# Altium schematic sheet mainboard.schdoc (part 2 of 2)
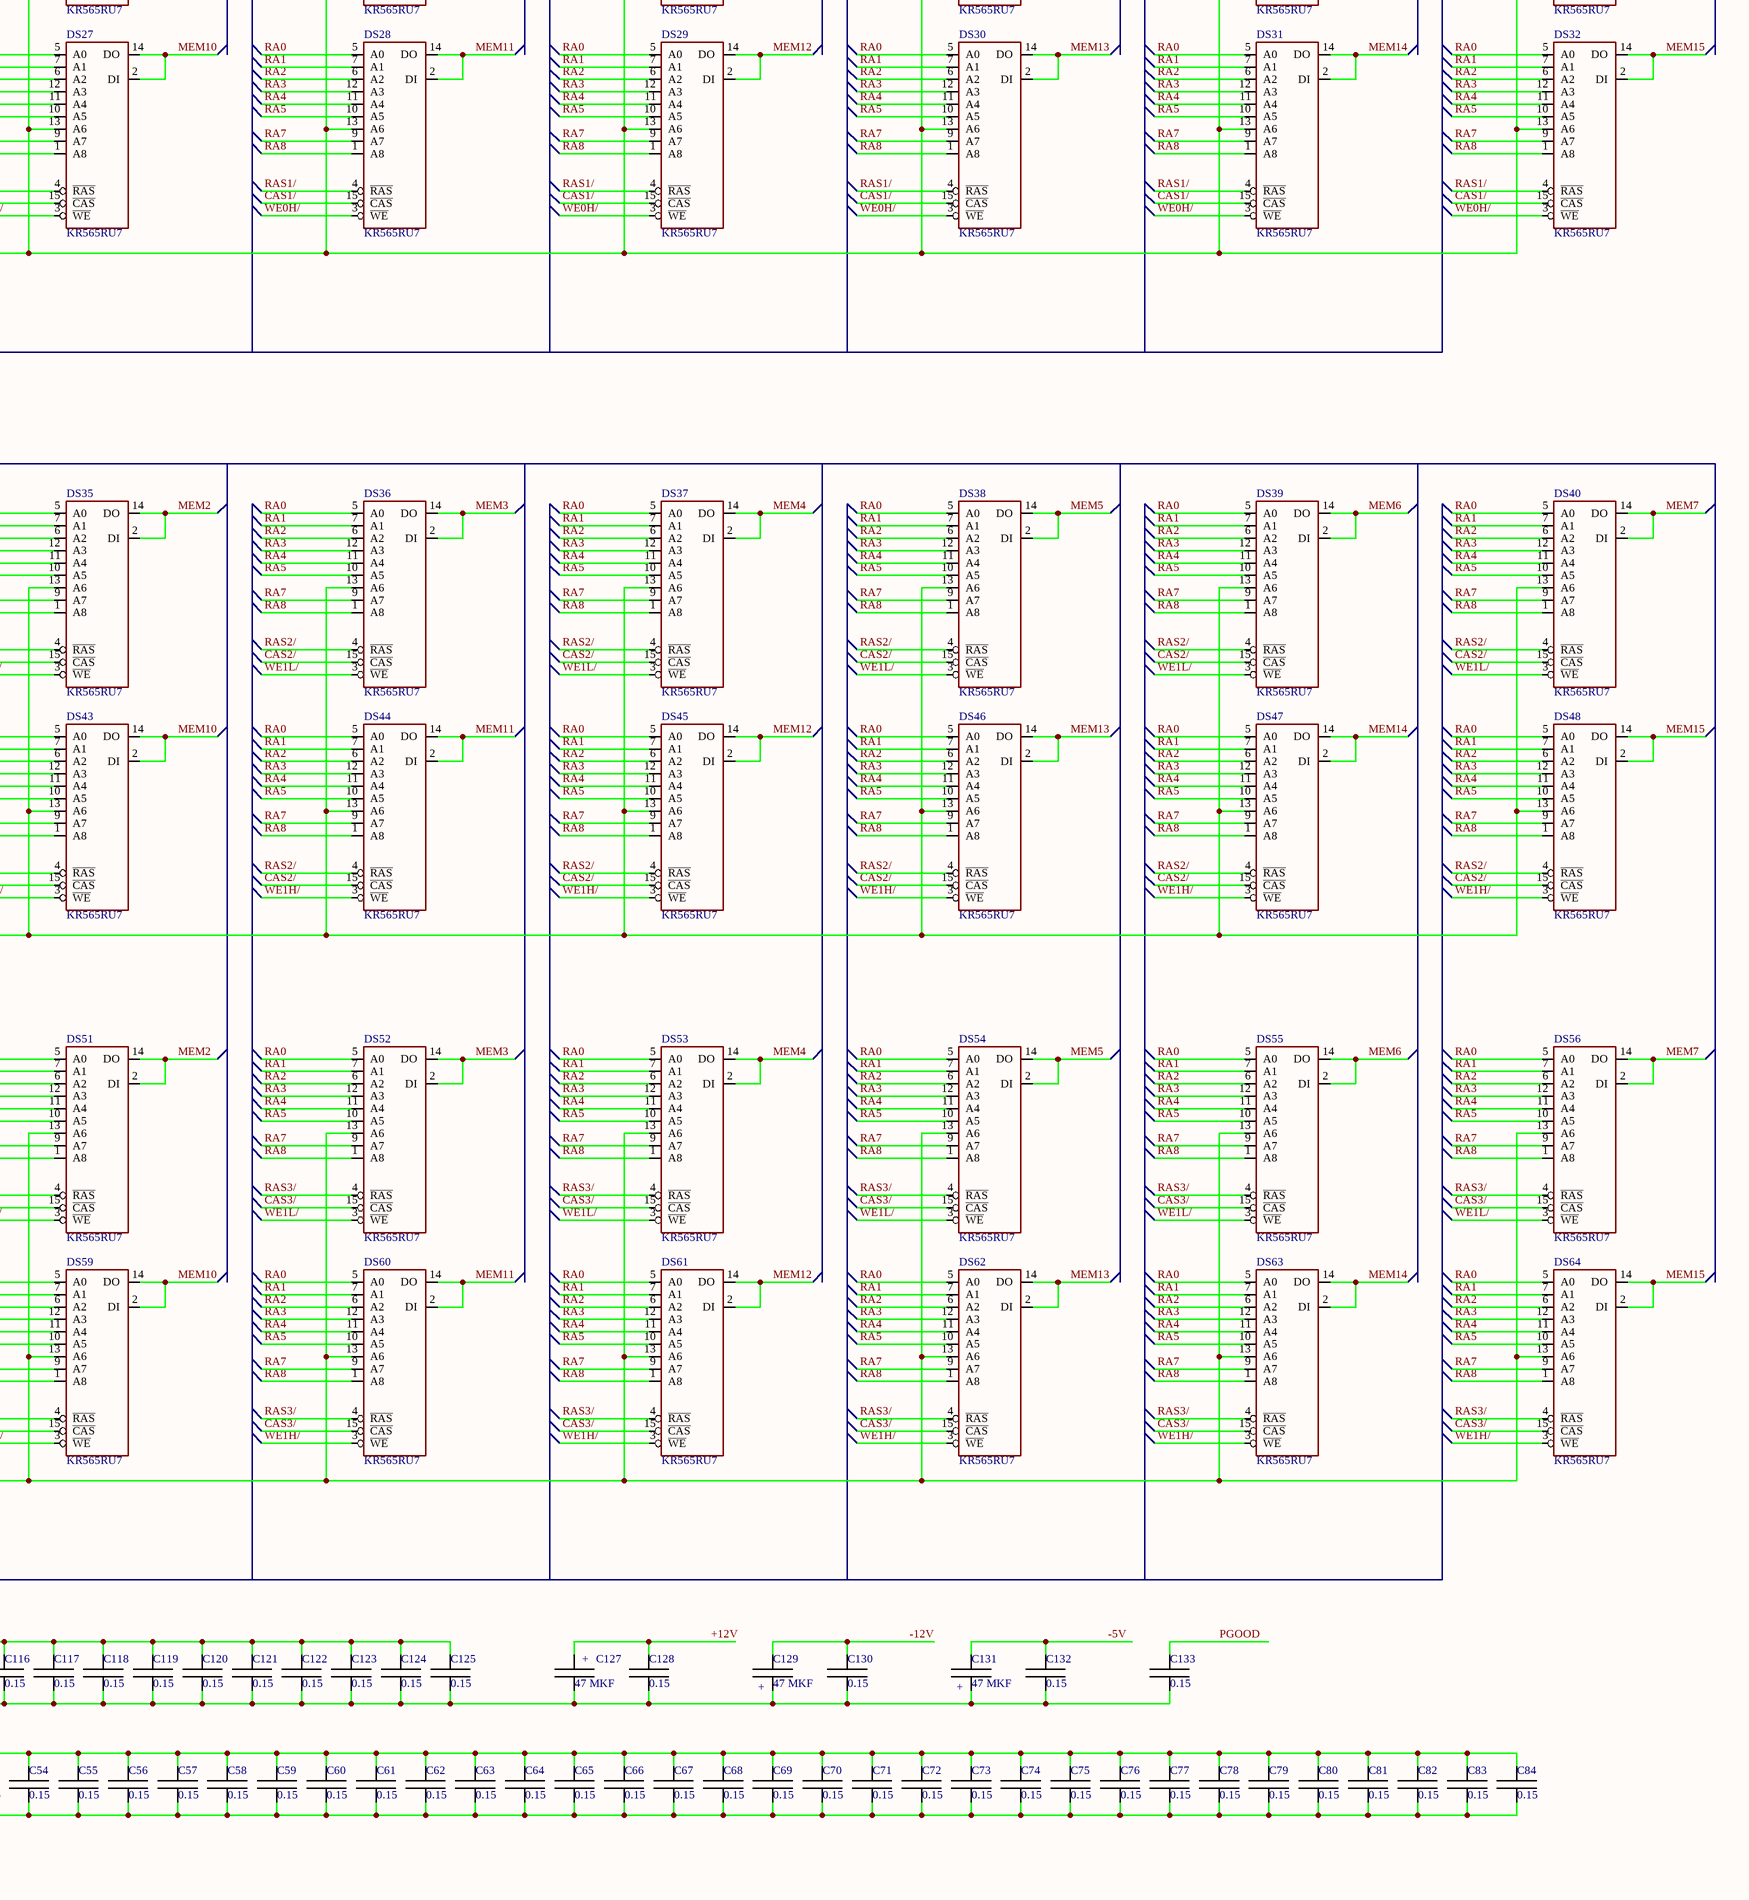
[diagram p6: mainboard.schdoc, bottom right]

## Nets
GND: BT1.2(-) C3.2 C4.2 C5.2 C6.2 C7.2 C8.2 C10.2 C11.2 C12.2 C13.2 C14.2 C15.2 C16.2 C17.2 C18.2 C19.2 C20.2 C21.2 C22.2 C23.2 C24.2 C25.2 C26.2 C27.2 C28.2 C29.2 C30.2 C31.2 C32.2 C33.2 C34.2 C35.2 C36.2 C37.2 C38.2 C39.2 C40.2 C41.2 C42.2 C43.2 C44.2 C45.2 C46.2 C47.2 C48.2 C49.2 C50.2 C51.2 C52.2 C53.2 C54.2 C55.2 C56.2 C57.2 C58.2 C59.2 C60.2 C61.2 C62.2 C63.2 C64.2 C65.2 C66.2 C67.2 C68.2 C69.2 C70.2 C71.2 C72.2 C73.2 C74.2 C75.2 C76.2 C77.2 C78.2 C79.2 C80.2 C81.2 C82.2 C83.2 C84.2 C85.2 C86.2 C87.2 C88.2 C89.2 C90.2 C91.2 C92.2 C93.2 C94.2 C95.2 C96.2 C97.2 C98.2 C99.2 C100.2 C101.2 C102.2 C103.2 C104.2 C105.2 C106.2 C107.2 C108.2 C109.2 C110.2 C111.2 C112.2 C113.2 C114.2 C115.2 C116.2 C117.2 C118.2 C119.2 C120.2 C121.2 C122.2 C123.2 C124.2 C125.2 C127.2 C128.2 C129.1 C130.2 C131.1 C132.2 C133.2 C134.2 D1.7 D2.7 D3.7 D4.7 D5.7 D6.7 D7.7 D7.8 D7.11 D8.8 D9.8 D10.7 D11.7 D12.1(A6) D12.8 D12.13(~{CE1}) D12.14(~{CE2}) D12.15(A7) D13.1(CSYNC) D13.6(RDY2) D13.7(~{AEN2}) D13.9 D13.13(F/~{C}) D14.7 D15.7 D16.7 D17.7 D18.7 D19.7 D20.8 D21.1 D21.20 D21.33(~{MX}) D22.1 D22.20 D23.7 D24.7 D25.10 D26.10 D27.10 D28.10 D29.10 D30.1(IOB) D30.10 D31.7 D32.8 D32.13(~{CE1}) D32.14(~{CE2}) D33.10 D34.7 D35.7 D36.7 D37.7 D38.10 D38.19(S1) D39.6(RO(1)) D39.7(RO(2)) D39.10 D40.14 D41.10 D42.7 D43.10 D44.12 D45.7 D46.10 D46.19(G) D47.20 D48.8 D49.12 D50.7 D51.2(A1) D51.10 D51.19(EY) D52.10 D53.1(EX) D53.10 D53.19(EY) D54.12(VSS) D55.1(A6) D55.8 D55.13(~{CE1}) D55.14(~{CE2}) D55.15(A7) D56.10 D57.10 D58.10 D59.14 D59.20(~{CE}) D60.14 D60.20(~{CE}) D61.7 D62.7 D63.7 D64.7 D65.7 D66.8 D67.10 D67.15(B3) D67.17(B4) D68.8 D69.8 D70.8(~{CS}) D70.9 D70.15(A9) D70.16(A8) D71.8(~{CS}) D71.9 D71.15(A9) D71.16(A8) D72.1(G) D72.10 D72.19(G) D73.8 D73.15(G) D74.8 D74.15(G) D75.1(1G) D75.8 D75.15(2G) D76.5(G2B) D76.8 D77.10 DS1.16 DS2.16 DS3.16 DS4.16 DS5.16 DS6.16 DS7.16 DS8.16 DS9.16 DS10.16 DS11.16 DS12.16 DS13.16 DS14.16 DS15.16 DS16.16 DS17.16 DS18.16 DS19.16 DS20.16 DS21.16 DS22.16 DS23.16 DS24.16 DS25.16 DS26.16 DS27.16 DS28.16 DS29.16 DS30.16 DS31.16 DS32.16 DS33.16 DS34.16 DS35.16 DS36.16 DS37.16 DS38.16 DS39.16 DS40.16 DS41.16 DS42.16 DS43.16 DS44.16 DS45.16 DS46.16 DS47.16 DS48.16 DS49.16 DS50.16 DS51.16 DS52.16 DS53.16 DS54.16 DS55.16 DS56.16 DS57.16 DS58.16 DS59.16 DS60.16 DS61.16 DS62.16 DS63.16 DS64.16 R5.2 R6.1 R9.1 R21.2 VT2.E X1.1 X4.4 X5.5 X5.6 X5.7 X5.8 X7.32(B1) X7.41(B10) X7.62(B31) X8.32(B1) X8.41(B10) X8.62(B31) X9.32(B1) X9.41(B10) X9.62(B31) X10.32(B1) X10.41(B10) X10.62(B31) X11.32(B1) X11.41(B10) X11.62(B31) X12.32(B1) X12.41(B10) X12.62(B31) X13.32(B1) X13.41(B10) X13.62(B31) X14.32(B1) X14.41(B10) X14.62(B31) X15.2
VCC: C8.1 C10.1 C11.1 C12.1 C13.1 C14.1 C15.1 C16.1 C17.1 C18.1 C19.1 C20.1 C21.1 C22.1 C23.1 C24.1 C25.1 C26.1 C27.1 C28.1 C29.1 C30.1 C31.1 C32.1 C33.1 C34.1 C35.1 C36.1 C37.1 C38.1 C39.1 C40.1 C41.1 C42.1 C43.1 C44.1 C45.1 C46.1 C47.1 C48.1 C49.1 C50.1 C51.1 C52.1 C53.1 C54.1 C55.1 C56.1 C57.1 C58.1 C59.1 C60.1 C61.1 C62.1 C63.1 C64.1 C65.1 C66.1 C67.1 C68.1 C69.1 C70.1 C71.1 C72.1 C73.1 C74.1 C75.1 C76.1 C77.1 C78.1 C79.1 C80.1 C81.1 C82.1 C83.1 C84.1 C85.1 C86.1 C87.1 C88.1 C89.1 C90.1 C91.1 C92.1 C93.1 C94.1 C95.1 C96.1 C97.1 C98.1 C99.1 C100.1 C101.1 C102.1 C103.1 C104.1 C105.1 C106.1 C107.1 C108.1 C109.1 C110.1 C111.1 C112.1 C113.1 C114.1 C115.1 C116.1 C117.1 C118.1 C119.1 C120.1 C121.1 C122.1 C123.1 C124.1 C125.1 D1.14 D2.14 D3.14 D4.14 D5.14 D6.14 D7.14 D8.16 D9.16 D10.14 D11.14 D12.16 D13.18 D14.14 D15.14 D16.14 D17.14 D18.14 D19.14 D20.16 D21.40 D22.33(RQ/GT1) D22.40 D23.14 D24.14 D25.20 D26.20 D27.20 D28.20 D29.20 D30.20 D31.14 D32.16 D33.20 D34.14 D35.14 D36.14 D37.14 D38.20 D39.5 D40.28 D41.20 D42.14 D43.20 D44.24 D45.26 D46.20 D47.31 D48.16 D49.11(G0) D49.14(G1) D49.24 D51.20 D52.20 D53.20 D55.16 D56.20 D57.20 D58.20 D59.1(VPP) D59.28 D60.1(VPP) D60.28 D61.14 D62.14 D63.14 D64.14 D65.14 D66.16 D67.20 D68.16 D69.16 D70.18 D71.18 D72.20 D73.16 D74.16 D75.16 D76.16 D77.20 DR1.1 DR2.1 DR3.1 DR7.1 DR8.1 DR9.1 DS1.8 DS2.8 DS3.8 DS4.8 DS5.8 DS6.8 DS7.8 DS8.8 DS9.8 DS10.8 DS11.8 DS12.8 DS13.8 DS14.8 DS15.8 DS16.8 DS17.8 DS18.8 DS19.8 DS20.8 DS21.8 DS22.8 DS23.8 DS24.8 DS25.8 DS26.8 DS27.8 DS28.8 DS29.8 DS30.8 DS31.8 DS32.8 DS33.8 DS34.8 DS35.8 DS36.8 DS37.8 DS38.8 DS39.8 DS40.8 DS41.8 DS42.8 DS43.8 DS44.8 DS45.8 DS46.8 DS47.8 DS48.8 DS49.8 DS50.8 DS51.8 DS52.8 DS53.8 DS54.8 DS55.8 DS56.8 DS57.8 DS58.8 DS59.8 DS60.8 DS61.8 DS62.8 DS63.8 DS64.8 R1.2 R2.1 R4.1 R7.1 R8.1 R10.2 R12.1 R13.1 R14.1 R15.1 R17.2 R20.2 R23.1 R25.2 R28.1 R29.2 R30.1 R31.2 R32.2 R33.2 R34.2 R35.2 R36.2 R37.2 VT1.E X2.2 X4.5 X5.2 X5.10 X5.11 X5.12 X7.34(B3) X7.60(B29) X8.34(B3) X8.60(B29) X9.34(B3) X9.60(B29) X10.34(B3) X10.60(B29) X11.34(B3) X11.60(B29) X12.34(B3) X12.60(B29) X13.34(B3) X13.60(B29) X14.34(B3) X14.60(B29)
+12V: C127.1 C128.1 X5.3 X7.40(B9) X8.40(B9) X9.40(B9) X10.40(B9) X11.40(B9) X12.40(B9) X13.40(B9) X14.40(B9)
-5V: C131.2 C132.1 X5.9 X7.36(B5) X8.36(B5) X9.36(B5) X10.36(B5) X11.36(B5) X12.36(B5) X13.36(B5) X14.36(B5)
-12V: C129.2 C130.1 X5.4 X7.38(B7) X8.38(B7) X9.38(B7) X10.38(B7) X11.38(B7) X12.38(B7) X13.38(B7) X14.38(B7)
A0: D23.13 D46.18(B1) D51.12(X4) D62.9 D64.2 D65.9 D68.14(WA) D69.14(WA) D75.5(1C1) D75.6(1C0) D75.10(2C0) D75.11(2C1) DR9.2 X7.31(A31) X8.31(A31) X9.31(A31) X10.31(A31) X11.31(A31) X12.31(A31) X13.31(A31) X14.31(A31)
A1: D27.5(Q1) D46.17(B2) D51.13(B2) D59.10(A0) D60.10(A0) D68.13(WB) D69.13(WB) D73.2(1A) DR9.3 X7.30(A30) X8.30(A30) X9.30(A30) X10.30(A30) X11.30(A30) X12.30(A30) X13.30(A30) X14.30(A30)
A2: D27.6(Q2) D46.16(B3) D59.9(A1) D60.9(A1) D73.5(2A) DR9.4 X7.29(A29) X8.29(A29) X9.29(A29) X10.29(A29) X11.29(A29) X12.29(A29) X13.29(A29) X14.29(A29)
A3: D27.9(Q3) D46.15(B4) D59.8(A2) D60.8(A2) D73.11(3A) DR9.5 X7.28(A28) X8.28(A28) X9.28(A28) X10.28(A28) X11.28(A28) X12.28(A28) X13.28(A28) X14.28(A28)
A4: D27.12(Q4) D44.23(A) D46.14(B5) D59.7(A3) D60.7(A3) D73.14(4A) DR9.6 X7.27(A27) X8.27(A27) X9.27(A27) X10.27(A27) X11.27(A27) X12.27(A27) X13.27(A27) X14.27(A27)
A5: D27.15(Q5) D44.22(B) D46.13(B6) D59.6(A4) D60.6(A4) D74.2(1A) DR9.7 X7.26(A26) X8.26(A26) X9.26(A26) X10.26(A26) X11.26(A26) X12.26(A26) X13.26(A26) X14.26(A26)
A6: D27.16(Q6) D44.21(C) D46.12(B7) D59.5(A5) D60.5(A5) D74.5(2A) DR9.8 X7.25(A25) X8.25(A25) X9.25(A25) X10.25(A25) X11.25(A25) X12.25(A25) X13.25(A25) X14.25(A25)
A7: D27.19(Q7) D44.20(D) D46.11(B8) D59.4(A6) D60.4(A6) D74.11(3A) DR9.9 X7.24(A24) X8.24(A24) X9.24(A24) X10.24(A24) X11.24(A24) X12.24(A24) X13.24(A24) X14.24(A24)
A8: D28.2(Q0) D42.4 D52.2(Q0) D59.3(A7) D60.3(A7) D74.14(4A) D75.4(1C2) DR9.10 X7.23(A23) X8.23(A23) X9.23(A23) X10.23(A23) X11.23(A23) X12.23(A23) X13.23(A23) X14.23(A23)
A9: D28.5(Q1) D42.5 D52.5(Q1) D59.25(A8) D60.25(A8) D75.3(1C3) D75.12(2C2) R33.1 X7.22(A22) X8.22(A22) X9.22(A22) X10.22(A22) X11.22(A22) X12.22(A22) X13.22(A22) X14.22(A22)
A10: D28.6(Q2) D52.6(Q2) D59.24(A9) D60.24(A9) D73.3(1B) DR8.10 X7.21(A21) X8.21(A21) X9.21(A21) X10.21(A21) X11.21(A21) X12.21(A21) X13.21(A21) X14.21(A21)
A11: D28.9(Q3) D52.9(Q3) D59.21(A10) D60.21(A10) D73.6(2B) DR8.9 X7.20(A20) X8.20(A20) X9.20(A20) X10.20(A20) X11.20(A20) X12.20(A20) X13.20(A20) X14.20(A20)
A12: D28.12(Q4) D52.12(Q4) D59.23(A11) D60.23(A11) D73.10(3B) DR8.8 X7.19(A19) X8.19(A19) X9.19(A19) X10.19(A19) X11.19(A19) X12.19(A19) X13.19(A19) X14.19(A19)
A13: D28.15(Q5) D52.15(Q5) D59.2(A12) D60.2(A12) D73.13(4B) DR8.7 X7.18(A18) X8.18(A18) X9.18(A18) X10.18(A18) X11.18(A18) X12.18(A18) X13.18(A18) X14.18(A18)
A14: D28.16(Q6) D52.16(Q6) D59.26(A13) D60.26(A13) D67.2(A1) D68.5(RA) D69.5(RA) DR8.6 X7.17(A17) X8.17(A17) X9.17(A17) X10.17(A17) X11.17(A17) X12.17(A17) X13.17(A17) X14.17(A17)
A15: D28.19(Q7) D52.19(Q7) D59.27(A14) D60.27(A14) D67.4(A2) D68.4(RB) D69.4(RB) DR8.5 X7.16(A16) X8.16(A16) X9.16(A16) X10.16(A16) X11.16(A16) X12.16(A16) X13.16(A16) X14.16(A16)
A16: D53.9(Y1) D55.5(A0) D67.6(A3) DR8.4 X7.15(A15) X8.15(A15) X9.15(A15) X10.15(A15) X11.15(A15) X12.15(A15) X13.15(A15) X14.15(A15)
A17: D53.7(Y2) D55.6(A1) D67.8(A4) DR8.3 X7.14(A14) X8.14(A14) X9.14(A14) X10.14(A14) X11.14(A14) X12.14(A14) X13.14(A14) X14.14(A14)
A18: D53.5(Y3) D55.7(A2) D67.11(B1) DR8.2 X7.13(A13) X8.13(A13) X9.13(A13) X10.13(A13) X11.13(A13) X12.13(A13) X13.13(A13) X14.13(A13)
A19: D53.3(Y4) D55.4(A3) D67.13(B2) DR7.10 X7.12(A12) X8.12(A12) X9.12(A12) X10.12(A12) X11.12(A12) X12.12(A12) X13.12(A12) X14.12(A12)
AD0: D21.16(AD0) D22.16(AD0) D25.2(A1) D27.3(D0) D33.2(Q0)
AD1: D21.15(AD1) D22.15(AD1) D25.4(A2) D27.4(D1) D33.5(Q1)
AD2: D21.14(AD2) D22.14(AD2) D25.6(A3) D27.7(D2) D33.6(Q2)
AD3: D21.13(AD3) D22.13(AD3) D25.8(A4) D27.8(D3) D33.9(Q3)
AD4: D21.12(AD4) D22.12(AD4) D25.11(B1) D27.13(D4) D33.12(Q4)
AD5: D21.11(AD5) D22.11(AD5) D25.13(B2) D27.14(D5) D33.15(Q5)
AD6: D21.10(AD6) D22.10(AD6) D25.15(B3) D27.17(D6) D33.16(Q6)
AD7: D21.9(AD7) D22.9(AD7) D25.17(B4) D27.18(D7) D33.19(Q7)
AD8: D21.8(AD8) D22.8(AD8) D26.2(A1) D28.3(D0) D41.2(A1)
AD9: D21.7(AD9) D22.7(AD9) D26.3(A2) D28.4(D1) D41.3(A2)
AD10: D21.6(AD10) D22.6(AD10) D26.4(A3) D28.7(D2) D41.4(A3)
AD11: D21.5(AD11) D22.5(AD11) D26.5(A4) D28.8(D3) D41.5(A4)
AD12: D21.4(AD12) D22.4(AD12) D26.6(A5) D28.13(D4) D41.6(A5)
AD13: D21.3(AD13) D22.3(AD13) D26.7(A6) D28.14(D5) D41.7(A6)
AD14: D21.2(AD14) D22.2(AD14) D26.8(A7) D28.17(D6) D41.8(A7)
AD14M: D71.14(D0) D74.3(1B) D77.2(A1)
AD15: D21.39(AD15) D22.39(AD15) D26.9(A8) D28.18(D7) D41.9(A8)
AD15M: D71.13(D1) D74.6(2B) D77.3(A2)
AD16: D21.38(A16/S3) D22.38(A16/S3) D29.3(D0)
AD16M: D71.12(D2) D74.10(3B) D77.4(A3)
AD17: D21.37(A17/S4) D22.37(A17/S4) D29.4(D1)
AD17M: D71.11(D3) D75.13(2C3) D77.5(A4)
AD18: D21.36(A18/S5) D22.36(A18/S5) D29.7(D2)
AD18M: D70.14(D0) D74.13(4B) D77.6(A5)
AD19: D21.35(A19/S6) D22.35(A19/S6) D29.8(D3)
AD19M: D70.13(D1) D76.1(A) D77.7(A6)
AD20M: D70.12(D2) D76.2(B) D77.8(A7)
AD21M: D70.11(D3) D76.3(C) D77.9(A8)
ADR0: D4.10 D18.3 D32.1(A6) D51.8(A4) D51.11(B1)
ADR14: D67.18(X1) D68.10(Q1) D70.5(A0) D71.5(A0)
ADR15: D67.16(X2) D68.9(Q2) D70.6(A1) D71.6(A1)
ADR16: D67.14(X3) D68.7(Q3) D70.7(A2) D71.7(A2)
ADR17: D67.12(X4) D68.6(Q4) D70.4(A3) D71.4(A3)
ADR18: D67.9(Y1) D69.10(Q1) D70.3(A4) D71.3(A4)
ADR19: D67.7(Y2) D69.9(Q2) D70.2(A5) D71.2(A5)
ADR20: D67.5(Y3) D69.7(Q3) D70.1(A6) D71.1(A6)
ADR21: D67.3(Y4) D69.6(Q4) D70.17(A7) D71.17(A7)
AEN: D51.18(X1) R23.2 X7.11(A11) X8.11(A11) X9.11(A11) X10.11(A11) X11.11(A11) X12.11(A11) X13.11(A11) X14.11(A11)
ALE: D19.2(D1) D30.5(ALE) X7.59(B28) X8.59(B28) X9.59(B28) X10.59(B28) X11.59(B28) X12.59(B28) X13.59(B28) X14.59(B28)
ASTB: D47.8(ADSTB) D52.11(G)
AUX/: D3.13 D7.9 D7.10 X1.2
BHE/: D21.34(~{BHE}/S7) D22.34(~{BHE}/S7) D29.13(D4)
BHEN/: D24.6(DO) D24.8(DO) D61.2 D65.5 R10.1
CADR0: D18.2 D27.2(Q0) D32.4(A3)
CAS0/: DR6.4 DS1.15(~{CAS}) DS2.15(~{CAS}) DS3.15(~{CAS}) DS4.15(~{CAS}) DS5.15(~{CAS}) DS6.15(~{CAS}) DS7.15(~{CAS}) DS8.15(~{CAS}) DS9.15(~{CAS}) DS10.15(~{CAS}) DS11.15(~{CAS}) DS12.15(~{CAS}) DS13.15(~{CAS}) DS14.15(~{CAS}) DS15.15(~{CAS}) DS16.15(~{CAS})
CAS1/: DR6.3 DS17.15(~{CAS}) DS18.15(~{CAS}) DS19.15(~{CAS}) DS20.15(~{CAS}) DS21.15(~{CAS}) DS22.15(~{CAS}) DS23.15(~{CAS}) DS24.15(~{CAS}) DS25.15(~{CAS}) DS26.15(~{CAS}) DS27.15(~{CAS}) DS28.15(~{CAS}) DS29.15(~{CAS}) DS30.15(~{CAS}) DS31.15(~{CAS}) DS32.15(~{CAS})
CAS2/: DR6.2 DS33.15(~{CAS}) DS34.15(~{CAS}) DS35.15(~{CAS}) DS36.15(~{CAS}) DS37.15(~{CAS}) DS38.15(~{CAS}) DS39.15(~{CAS}) DS40.15(~{CAS}) DS41.15(~{CAS}) DS42.15(~{CAS}) DS43.15(~{CAS}) DS44.15(~{CAS}) DS45.15(~{CAS}) DS46.15(~{CAS}) DS47.15(~{CAS}) DS48.15(~{CAS})
CAS3/: DR6.1 DS49.15(~{CAS}) DS50.15(~{CAS}) DS51.15(~{CAS}) DS52.15(~{CAS}) DS53.15(~{CAS}) DS54.15(~{CAS}) DS55.15(~{CAS}) DS56.15(~{CAS}) DS57.15(~{CAS}) DS58.15(~{CAS}) DS59.15(~{CAS}) DS60.15(~{CAS}) DS61.15(~{CAS}) DS62.15(~{CAS}) DS63.15(~{CAS}) DS64.15(~{CAS})
CASEN/: D62.3 D76.4(G2A)
CBHEN/: D24.9(DI) D29.12(Q4) D32.3(A4)
CEN: D20.2(Q1) D30.15(CEN)
CLK: D1.3(C1) D3.4 D9.9(CLK) D16.1 D17.1 D17.2 D20.9(CLK) D21.19(CLK) D22.19(CLK) D30.2(CLK) R38.1 R38.2 S1.4
CLK/: D5.3(C1) D10.3(C1) D16.2 D35.11(C2)
CLOCK: D17.3 X7.51(B20) X8.51(B20) X9.51(B20) X10.51(B20) X11.51(B20) X12.51(B20) X13.51(B20) X14.51(B20)
CLRKB: D23.3 D38.2(G1) D38.3(G2) D45.25(PB7)
CRDY: D13.5(READY) D21.22(READY) D22.22(READY)
D0: D25.18(X1) D26.18(B1) D33.3(D0) D43.18(B1) D56.18(B1) D57.18(B1) DR7.9 X7.9(A9) X8.9(A9) X9.9(A9) X10.9(A9) X11.9(A9) X12.9(A9) X13.9(A9) X14.9(A9)
D1: D25.16(X2) D26.17(B2) D33.4(D1) D43.17(B2) D56.17(B2) D57.17(B2) DR7.8 X7.8(A8) X8.8(A8) X9.8(A8) X10.8(A8) X11.8(A8) X12.8(A8) X13.8(A8) X14.8(A8)
D2: D25.14(X3) D26.16(B3) D33.7(D2) D43.16(B3) D56.16(B3) D57.16(B3) DR7.7 X7.7(A7) X8.7(A7) X9.7(A7) X10.7(A7) X11.7(A7) X12.7(A7) X13.7(A7) X14.7(A7)
D3: D25.12(X4) D26.15(B4) D33.8(D3) D43.15(B4) D56.15(B4) D57.15(B4) DR7.6 X7.6(A6) X8.6(A6) X9.6(A6) X10.6(A6) X11.6(A6) X12.6(A6) X13.6(A6) X14.6(A6)
D4: D25.9(Y1) D26.14(B5) D33.13(D4) D43.14(B5) D56.14(B5) D57.14(B5) DR7.5 X7.5(A5) X8.5(A5) X9.5(A5) X10.5(A5) X11.5(A5) X12.5(A5) X13.5(A5) X14.5(A5)
D5: D25.7(Y2) D26.13(B6) D33.14(D5) D43.13(B6) D56.13(B6) D57.13(B6) DR7.4 X7.4(A4) X8.4(A4) X9.4(A4) X10.4(A4) X11.4(A4) X12.4(A4) X13.4(A4) X14.4(A4)
D6: D25.5(Y3) D26.12(B7) D33.17(D6) D43.12(B7) D56.12(B7) D57.12(B7) DR7.3 X7.3(A3) X8.3(A3) X9.3(A3) X10.3(A3) X11.3(A3) X12.3(A3) X13.3(A3) X14.3(A3)
D7: D25.3(Y4) D26.11(B8) D33.18(D7) D43.11(B8) D56.11(B8) D57.11(B8) DR7.2 X7.2(A2) X8.2(A2) X9.2(A2) X10.2(A2) X11.2(A2) X12.2(A2) X13.2(A2) X14.2(A2)
D8: D41.18(B1) D57.2(A1) D58.18(B1)
D9: D41.17(B2) D57.3(A2) D58.17(B2)
D10: D41.16(B3) D57.4(A3) D58.16(B3)
D11: D41.15(B4) D57.5(A4) D58.15(B4)
D12: D41.14(B5) D57.6(A5) D58.14(B5)
D13: D41.13(B6) D57.7(A6) D58.13(B6)
D14: D41.12(B7) D57.8(A7) D58.12(B7)
D15: D41.11(B8) D57.9(A8) D58.11(B8)
DACK0/: D35.1(~{R1}) D47.25(DACK0) D55.2(A5) D63.2 D75.2(B) D76.6(G1) X7.50(B19) X8.50(B19) X9.50(B19) X10.50(B19) X11.50(B19) X12.50(B19) X13.50(B19) X14.50(B19)
DACK1/: D47.24(DACK1) X7.48(B17) X8.48(B17) X9.48(B17) X10.48(B17) X11.48(B17) X12.48(B17) X13.48(B17) X14.48(B17)
DACK2/: D47.14(DACK2) D48.4(RB) X7.57(B26) X8.57(B26) X9.57(B26) X10.57(B26) X11.57(B26) X12.57(B26) X13.57(B26) X14.57(B26)
DACK3/: D47.15(DACK3) D48.5(RA) X7.46(B15) X8.46(B15) X9.46(B15) X10.46(B15) X11.46(B15) X12.46(B15) X13.46(B15) X14.46(B15)
DEN: D6.2(D1) D11.1 D14.12 D30.16(DEN) D32.15(A7)
DIR: D31.12 D56.1(DIR) D57.1(DIR) D58.1(DIR)
DLAEN/: D9.7(Q3) D9.11(D4) D12.2(A5) D14.2
DMAA0: D40.27(AO) D46.2(A1) D47.32(A0) D48.14(WA)
DMAA1: D46.3(A2) D47.33(A1) D48.13(WB)
DMAA2: D46.4(A3) D47.34(A2)
DMAA3: D46.5(A4) D47.35(A3)
DMAA4: D46.6(A5) D47.37(A4)
DMAA5: D46.7(A6) D47.38(A5)
DMAA6: D46.8(A7) D47.39(A6)
DMAA7: D46.9(A8) D47.40(A7)
DMAAEN: D23.2 D46.1(DIR) D62.10
DMAAEN/: D14.3 D23.1 D48.11(GR) D52.1(OC)
DMAD16: D29.2(Q0) D48.10(Q1) D53.11(B1)
DMAD17: D29.5(Q1) D48.9(Q2) D53.13(B2)
DMAD18: D29.6(Q2) D48.7(Q3) D53.15(B3)
DMAD19: D29.9(Q3) D48.6(Q4) D53.17(B4)
DMARDY: D3.8 D47.6(READY)
DMAS/: D44.1(0) D47.11(~{CS})
DRQ0: D35.5(Q1) D47.19(DRQ0)
DRQ1: D47.18(DRQ1) X7.49(B18) X8.49(B18) X9.49(B18) X10.49(B18) X11.49(B18) X12.49(B18) X13.49(B18) X14.49(B18)
DRQ2: D47.17(DRQ2) X7.37(B6) X8.37(B6) X9.37(B6) X10.37(B6) X11.37(B6) X12.37(B6) X13.37(B6) X14.37(B6)
DRQ3: D47.16(DRQ3) X7.47(B16) X8.47(B16) X9.47(B16) X10.47(B16) X11.47(B16) X12.47(B16) X13.47(B16) X14.47(B16)
DT/R: D11.5 D18.12 D26.1(DIR) D30.4(DT/~{R}) D41.1(DIR)
EMS/: D55.9(O4) D63.13 R28.2
EMSS/: D44.16(14) D61.9
ENKB: D23.5 D45.24(PB6)
GATE2: D45.18(PB0) D49.16(G2)
HLDA: D5.5(Q1) D9.4(D2) D47.7(HLDA)
HRDY: D3.1 D14.8
HRQ: D2.13 D5.1(~{R1}) D47.10(HRQ)
I/O CH CK: X7.1(A1) X8.1(A1) X9.1(A1) X10.1(A1) X11.1(A1) X12.1(A1) X13.1(A1) X14.1(A1)
I/O CH RDY: D1.2(D1) D3.2 R36.1 X7.10(A10) X8.10(A10) X9.10(A10) X10.10(A10) X11.10(A10) X12.10(A10) X13.10(A10) X14.10(A10)
INTA/: D2.1 D14.4 D17.4 D30.14(INTA) D40.26(INTA) DR3.9